# EasyEDA Pro project MushIO_V1p0_Final.eprj, schematic 4chAFE
Board Name: 4chAFE; Create Date: 2025-11-03; Page Name: 4ch_AFE; Project Name: MushIO_V1p2; Schematic Name: 4chAFE; Update Date: 2025-11-23; Company: EasyEDA.com; Page Size: A4; Version: V1.0
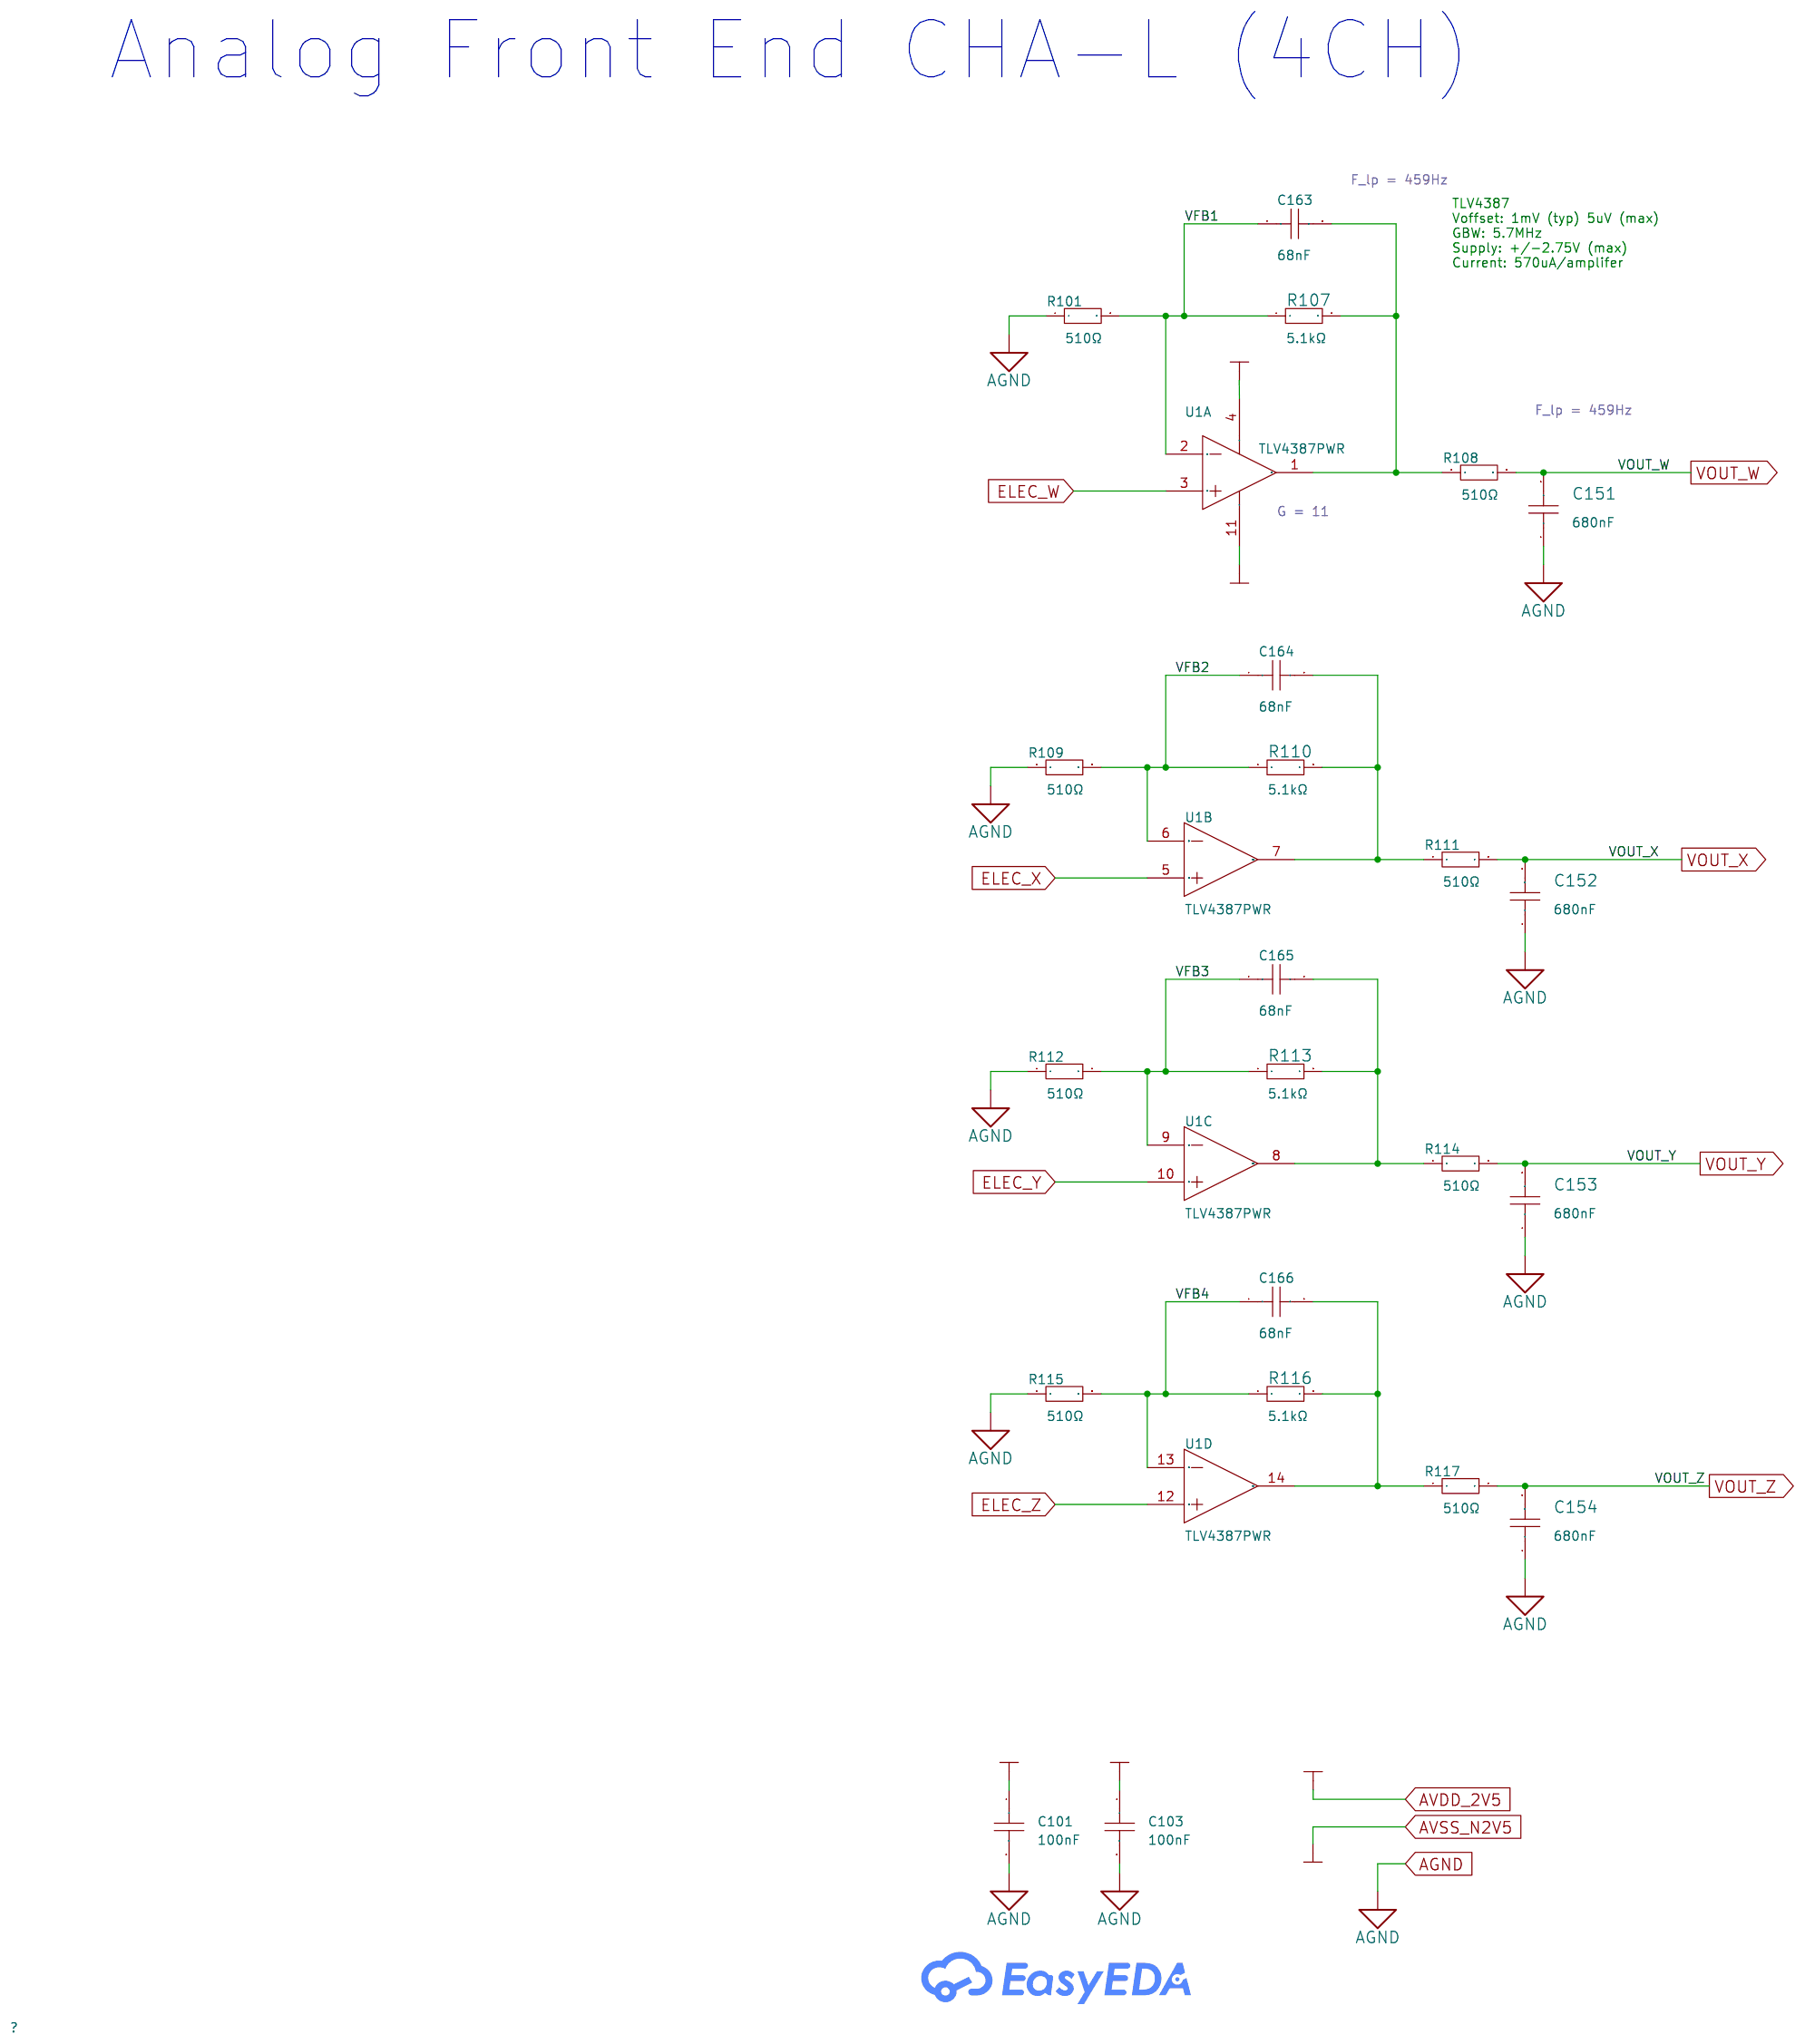
[diagram p0: schematic sheet]

## Parts
C101  100nF  [C0402]
C103  100nF  [C0402]
C151  680nF  [C0402]
C152  680nF  [C0402]
C153  680nF  [C0402]
C154  680nF  [C0402]
C163  68nF  [C0402]
C164  68nF  [C0402]
C165  68nF  [C0402]
C166  68nF  [C0402]
R101  510Ω  [R0402]
R107  5.1kΩ  [R0402]
R108  510Ω  [R0402]
R109  510Ω  [R0402]
R110  5.1kΩ  [R0402]
R111  510Ω  [R0402]
R112  510Ω  [R0402]
R113  5.1kΩ  [R0402]
R114  510Ω  [R0402]
R115  510Ω  [R0402]
R116  5.1kΩ  [R0402]
R117  510Ω  [R0402]
U1  TLV4387PWR  [TSSOP-14_L5.0-W4.4-P0.65-LS6.4-BL]  (sections 1,2,3,4)

## Library data of the parts
C101 C103 = CL05B104KO5NNNC: Capacitance: Tolerance:±10% Tolerance:±10% Voltage Rated: Temperature Coefficient:; LCSC Part Name: 100nF ±10% 16V; Supplier Part: C1525; Manufacturer: SAMSUNG(三星); Supplier Footprint: 0402; JLCPCB Part Class: Basic Part; Datasheet: https://atta.szlcsc.com/upload/public/pdf/source/20160218/1457707763339.pdf; Supplier: LCSC; Tolerance: ±10%
C151-C154 = CC0402KRX5R6BB684: Capacitance:680nF Tolerance:±10% Tolerance:±10% Voltage Rating:10V Temperature Coefficient:X5R; LCSC Part Name: 680nF ±10% 10V; Supplier Part: C113784; Manufacturer: YAGEO(国巨); Supplier Footprint: 0402; JLCPCB Part Class: Extended Part; Datasheet: https://item.szlcsc.com/datasheet/CC0402KRX5R6BB684/115020.html; Supplier: LCSC; Tolerance: ±10%; Voltage Rating: 10V; Temperature Coefficient: X5R
C163-C166 = TCC0402X7R683K250AT: Capacitance:68nF Tolerance:±10% Tolerance:±10% Voltage Rating:25V Temperature Coefficient:X7R; LCSC Part Name: 68nF ±10% 25V; Supplier Part: C5448849; Manufacturer: CCTC(三环); Supplier Footprint: 0402; JLCPCB Part Class: Extended Part; Datasheet: https://item.szlcsc.com/datasheet/TCC0402X7R683K250AT/6350812.html; Supplier: LCSC; Tolerance: ±10%; Voltage Rating: 25V; Temperature Coefficient: X7R
R101 R108 R109 R111 R112 R114 R115 R117 = 0402WGF5100TCE: Type:Thick Film Resistors Resistance: Tolerance:±1% Tolerance:±1% Power(Watts): Overload Voltage (Max): Temperature Coefficient:±100ppm/℃ Temperature Coefficient:±100ppm/℃ Operating Temperature Range:-55℃~+155℃ Operating Temperature Range:-55℃~+155℃; LCSC Part Name: 510Ω ±1% 62.5mW 厚膜电阻; Supplier Part: C25123; Manufacturer: UNI-ROYAL(厚声); Supplier Footprint: 0402; JLCPCB Part Class: Basic Part; Datasheet: https://atta.szlcsc.com/upload/public/pdf/source/20200306/C422600_1E6D84923E4A46A82E41ADD87F860B5C.pdf; Supplier: LCSC; Type: Thick Film Resistors; Tolerance: ±1%; Temperature Coefficient: ±100ppm/℃; Operating Temperature Range: -55℃~+155℃
R107 R110 R113 R116 = 0402WGF5101TCE: Type:Thick Film Resistor Resistance:5.1kΩ Tolerance:±1% Tolerance:±1% Power(Watts):62.5mW Voltage-Supply(Max):50V Temperature Coefficient:±100ppm/℃ Temperature Coefficient:±100ppm/℃ Operating Temperature:-55℃~+155℃ Operating Temperature:-55℃~+155℃; LCSC Part Name: 5.1kΩ ±1% 62.5mW 厚膜电阻; Supplier Part: C25905; Manufacturer: UNI-ROYAL(厚声); Supplier Footprint: 0402; JLCPCB Part Class: Basic Part; Datasheet: https://item.szlcsc.com/datasheet/0402WGF5101TCE/26648.html; Supplier: LCSC; Type: Thick Film Resistor; Tolerance: ±1%; Power(Watts): 62.5mW; Voltage-Supply(Max): 50V; Temperature Coefficient: ±100ppm/℃; Operating Temperature: -55℃~+155℃
U1 = TLV4387PWR_C32013385: Number of Channels:4 Gain Bandwidth Product:5.7MHz Ib - Input Bias Current:300pA Vos - Input Offset Voltage:5uV Common Mode Rejection Ratio(CMRR):130dB Slew Rate:2.8V/us Output Current:15mA Rail to Rail:Rail-to-Rail Input Input Offset Voltage Drift(Vos TC; Supplier Part: C32013385; Manufacturer: TI(德州仪器); Supplier Footprint: TSSOP-14; JLCPCB Part Class: Extended Part; Datasheet: https://www.ti.com.cn/cn/lit/ds/symlink/tlv4387.pdf; Supplier: LCSC; Number of Channels: 4; Gain Bandwidth Product: 5.7MHz; Ib - Input Bias Current: 300pA; Vos - Input Offset Voltage: 5uV; Common Mode Rejection Ratio(CMRR): 130dB; Slew Rate: 2.8V/us; Output Current: 15mA; Rail to Rail: Rail-to-Rail Input; Input Offset Voltage Drift(Vos TC): 10nV/℃; Quiescent Current(Iq): 570uA; Operating Temperature: -40℃~+125℃; Single Supply: 1.7V~5.5V; Dual Supply: -2.75V~-850mV；850mV~2.75V; Maximum Power Supply Range (Vdd-Vss): 5.5V; Noise density(eN): 8.5nV/√Hz@1kHz; Input Offset Current(Ios): 700pA

## Nets
AGND: C101.2 C103.2 C151.1 C152.1 C153.1 C154.1 R101.1 R109.1 R112.1 R115.1
AVDD_2V5: C101.1 U1.4(V+)
AVSS_N2V5: C103.1 U1.11(V-)
ELEC_W: U1.3(INA+)
ELEC_X: U1.5(INB+)
ELEC_Y: U1.10(INC+)
ELEC_Z: U1.12(IND+)
VFB1: C163.1 R101.2 R107.1 U1.2(INA−)
VFB2: C164.1 R109.2 R110.1 U1.6(INB−)
VFB3: C165.1 R112.2 R113.1 U1.9(INC−)
VFB4: C166.1 R115.2 R116.1 U1.13(IND−)
VOUT_W: C151.2 R108.2
VOUT_X: C152.2 R111.2
VOUT_Y: C153.2 R114.2
VOUT_Z: C154.2 R117.2
$3N2543: C163.2 R107.2 R108.1 U1.1(OUTA)
$3N3156: C164.2 R110.2 R111.1 U1.7(OUTB)
$3N3675: C165.2 R113.2 R114.1 U1.8(OUTC)
$3N3903: C166.2 R116.2 R117.1 U1.14(OUTD)

## Notes on the sheet
- Analog Front End CHA-L (4CH)
- F_lp = 459Hz
- TLV4387
  Voffset: 1mV (typ) 5uV (max)
  GBW: 5.7MHz
  Supply: +/-2.75V (max)
  Current: 570uA/amplifer
- F_lp = 459Hz
- G = 11
